# EasyEDA Pro project Chessboards.epro, board Diagonal (continued)
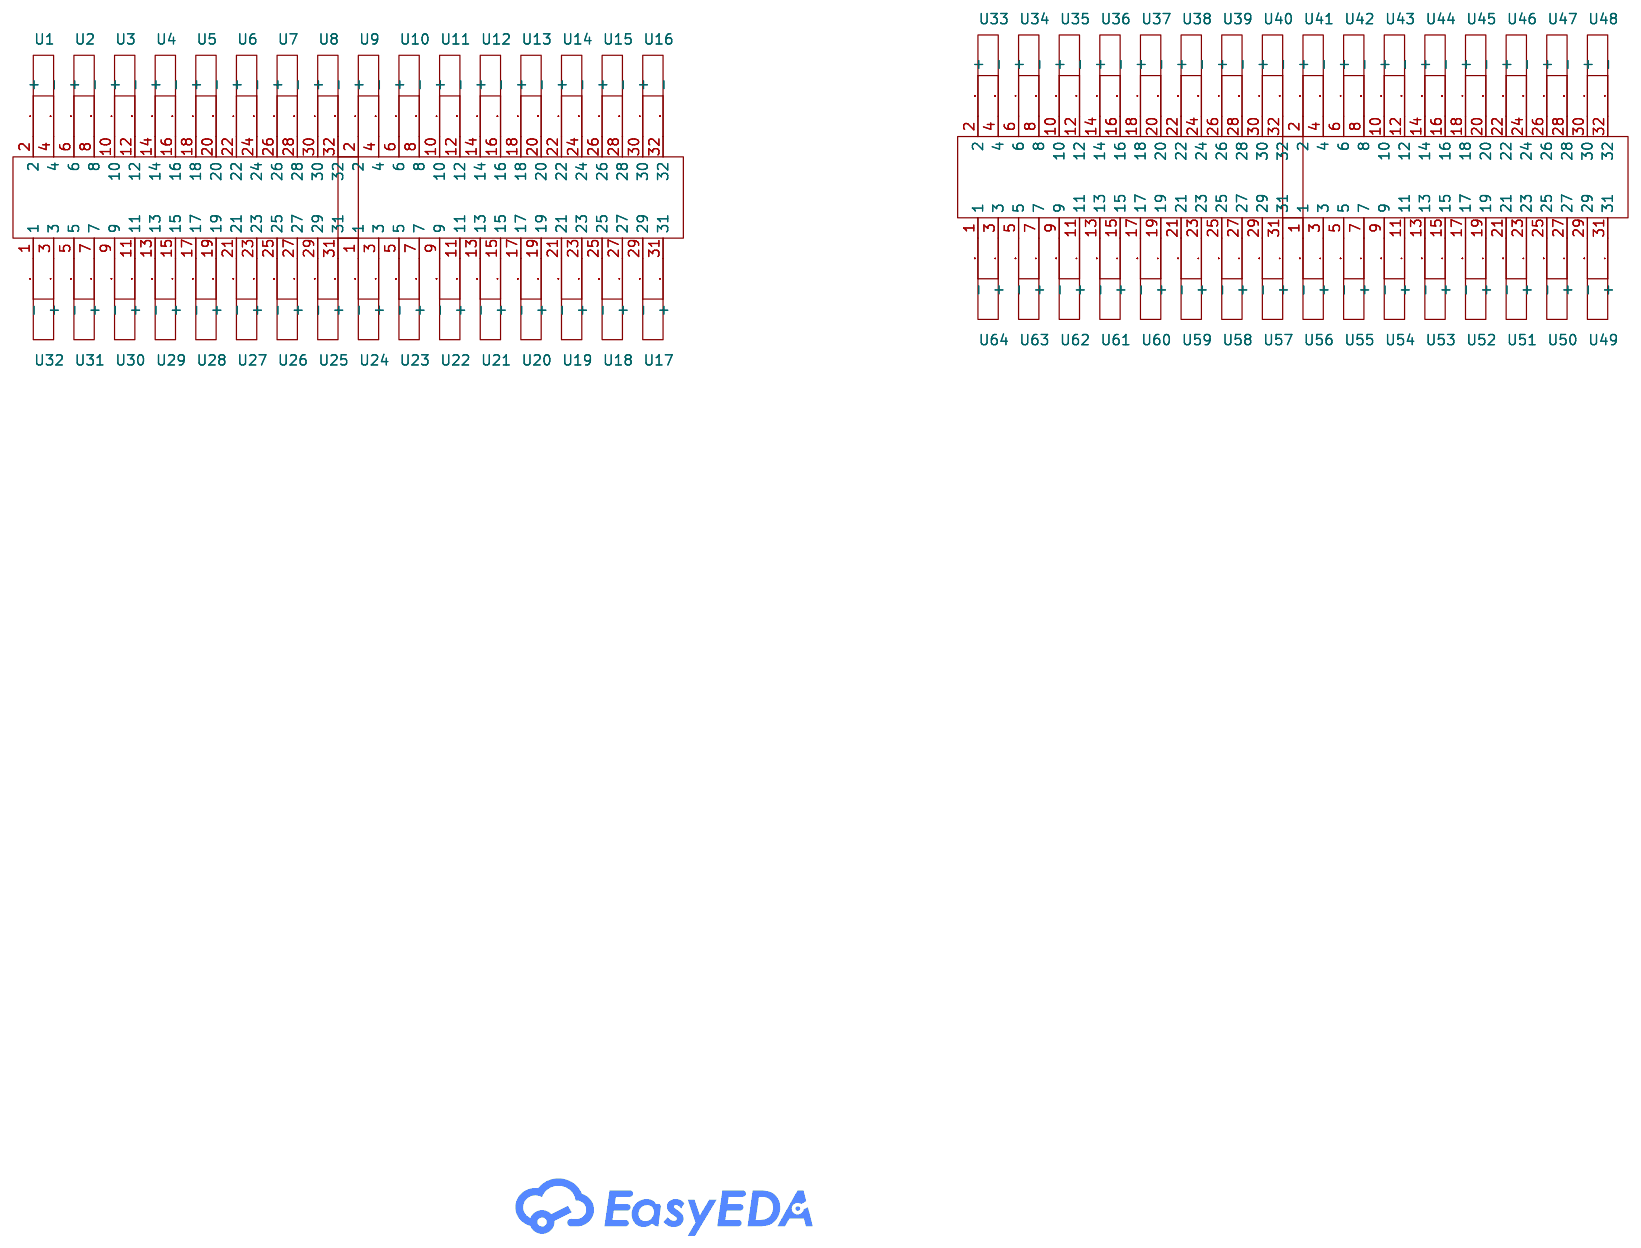
[diagram p0: schematic sheet]
## Routing (per net, layer and track width the routed paths; a pad name or vN(x,y) marks a point on that pad's centre or on a via; arc(x,y) is an arc through that point) (continued)
393.55,470.43 393.55,473.09 393.55,473.1 ; v2(243.69,476.35) 243.37,476.66 243.37,478.03 243.69,478.35 ; v2(302.61,3.69) 302.61,1.4 ; v2(241.14,476.35) 240.82,476.66 240.82,478.03 241.14,478.35 ; 290.01,6.99 290,6.99 290,9.65 v2(290.51,10.16) ; 164.57,472.99 164.45,472.99 164.44,472.98 164.44,470.86 165.43,469.87 ; v2(65.28,476.35) 65.28,478.64 ; 400.92,1.72 400.6,2.03 400.6,3.4 v2(400.92,3.72) ; 329.83,476.69 329.83,478.03 ; 329.83,476.69 v2(330.15,476.37) ; 329.83,478.03 329.83,478.06 330.15,478.37 ; 329.83,478.03 330.15,478.35 ; v2(137.75,476.36) 137.75,478.64 ; 445.15,7.01 445.15,7.01 445.15,9.67 v2(445.66,10.18) ; 387.04,476.4 387.04,478.68 ; v2(470.94,476.36) 470.94,478.64 ; v2(448.21,10.18) 447.7,9.67 447.7,7.01 447.7,7.01 ; 460.16,469.92 459.65,470.43 459.65,473.09 459.65,473.09 ; 149.33,473.07 149.33,470.41 149.84,469.9 ; v2(219.14,476.35) 219.14,478.64 ; v2(178.19,469.85) 177.23,470.82 177.23,472.96 177.23,472.96 ; v2(74.1,3.72) 73.78,3.4 73.78,2.03 74.1,1.72 ; 236.88,1.72 236.56,2.03 236.56,3.4 v2(236.88,3.72) ; 390.86,476.4 390.86,478.68 ; v2(76.74,476.35) 76.74,478.64 ; v2(57.84,10.19) 57.33,9.68 57.33,7.02 57.33,7.01 ; v2(212.32,3.71) 212.32,1.43 ; 304.02,6.99 304.02,6.99 304.02,9.65 v2(304.53,10.16) ; 159.47,472.99 159.47,472.98 159.47,470.74 160.33,469.87 ; v2(306.43,3.69) 306.43,1.4 ; 404.74,1.72 404.42,2.03 404.42,3.4 v2(404.74,3.72) ; 236.62,7.11 236.6,7.11 236.55,7.16 236.55,9.28 v2(237.48,10.22) ; v2(394.55,3.72) 394.23,3.4 394.23,2.03 394.55,1.72 ; v2(376.37,3.71) 376.37,1.43 ; v2(385.73,476.35) 385.73,478.64 ; 403.21,7.11 403.19,7.11 403.16,7.13 403.16,9.3 v2(404.07,10.22) ; v2(136.03,3.71) 136.03,1.42 ; v2(234.43,476.35) 234.43,478.64 ; 175.62,469.87 174.71,470.79 174.71,472.96 174.74,472.99 ; v2(63.38,469.88) 62.87,470.39 62.87,473.05 62.87,473.05 ; 315.82,476.69 315.82,476.66 316.13,476.35 ; 315.82,476.69 v2(316.13,476.37) ; 469.84,473.09 469.84,473.09 469.84,470.43 470.35,469.92 ; 315.88,470.74 v2(316.74,469.87) ; v2(236.35,469.88) 235.84,470.39 235.84,473.05 235.84,473.05 ; v2(455.65,476.36) 455.65,478.64 ; v2(395.82,3.72) 395.5,3.4 395.5,2.03 395.82,1.72 ; 162.27,476.37 161.96,476.69 161.96,478.06 162.27,478.37 ; v2(90.66,3.72) 90.34,3.4 90.34,2.03 90.66,1.72 ; 403.47,1.72 403.15,2.03 403.15,3.4 v2(403.47,3.72) ; v2(371.27,3.71) 371.27,1.43 ; 169.69,472.96 169.69,472.96 169.69,470.72 v2(170.55,469.85) ; 386.42,469.92 385.91,470.43 385.91,473.09 385.91,473.1 ; 288.73,6.99 288.73,6.99 288.73,9.65 v2(289.24,10.16) ; v2(321.23,476.37) 320.92,476.69 ; 320.92,476.69 320.92,476.66 321.23,476.35 ; v2(163.13,3.71) 162.81,3.4 162.81,2.03 163.13,1.71 ; v2(446.29,3.71) 446.29,1.42 ; v2(139.02,476.36) 139.02,478.64 ; 244.52,1.72 244.2,2.03 244.2,3.4 v2(244.52,3.72) ; v2(162.3,476.35) 161.98,476.67 161.98,478.03 162.3,478.35 ; v2(381.9,476.35) 381.9,478.64 ; 147.63,7.01 147.63,7.01 147.63,9.67 v2(148.14,10.18) ; 156.76,1.71 156.44,2.03 156.44,3.4 v2(156.76,3.71) ; 320.98,472.96 320.98,472.96 ; 327.35,472.96 327.35,472.98 327.35,472.99 ; 327.35,472.96 327.35,472.96 ; 238.59,478.35 238.28,478.03 238.28,476.66 v2(238.59,476.35) ; v2(219.34,10.19) 218.83,9.68 218.83,7.02 218.83,7.01 ; v2(59.74,3.71) 59.74,1.43 ; 463.33,476.39 463.33,478.68 ; v2(305.15,3.69) 305.15,1.4 ; 458.38,473.09 458.37,473.09 458.37,470.43 458.89,469.92 ; 169.25,469.87 168.39,470.74 168.39,472.98 ; 456.96,476.39 456.96,478.68 ; 166.12,478.35 165.8,478.03 165.8,476.67 v2(166.12,476.35) ; v2(151.13,469.88) 150.62,470.39 150.62,473.05 150.63,473.05 ; 59.05,473.05 59.04,473.05 59.04,470.39 v2(59.56,469.88) ; v2(366.17,3.71) 366.17,1.43 ; 176.29,478.37 175.97,478.06 175.97,476.69 176.29,476.37 ; 84.73,478.35 84.42,478.03 84.42,476.66 v2(84.73,476.35) ; 168.67,478.35 168.35,478.03 168.35,476.67 v2(168.67,476.35) ; v2(146.66,476.36) 146.66,478.64 ; v2(239.87,476.35) 239.55,476.66 239.55,478.03 239.87,478.35 ; 93.65,478.35 93.33,478.03 93.33,476.66 v2(93.65,476.35) ; v2(55.91,3.71) 55.91,1.43 ; v2(308.66,10.19) 307.79,9.33 307.79,7.08 307.8,7.08 ; 319.7,470.74 319.7,470.71 320.57,469.85 ; 319.7,470.74 v2(320.57,469.87) ; v2(52.09,3.71) 52.09,1.43 ; 304.32,476.35 304.32,478.66 ; 393.41,476.4 393.41,478.68 ; v2(158.48,476.35) 158.16,476.67 158.16,478.03 158.48,478.35 ; 155.7,473.07 155.7,470.41 156.21,469.9 ; v2(325.88,3.69) 325.57,3.38 325.57,2.01 325.88,1.69 ; 245.54,7.11 245.52,7.11 245.49,7.13 245.49,9.3 v2(246.4,10.22) ; 378.26,473.1 378.26,473.09 378.26,470.43 378.77,469.92 ; v2(456.48,3.71) 456.48,1.42 ; v2(303.88,3.69) 303.88,1.4 ; v2(377.64,3.71) 377.64,1.43 ; v2(472.21,476.36) 472.21,478.64 ; 395.64,469.89 394.78,470.76 394.78,473 394.78,473 ; v2(214.87,3.71) 214.87,1.43 ; 149.35,473.05 149.35,473.05 149.35,470.39 v2(149.86,469.88) ; 245.79,1.72 245.48,2.03 245.48,3.4 v2(245.79,3.72) ; 323.46,476.69 v2(323.78,476.37) ; 323.46,476.69 323.46,476.66 323.78,476.35 ; 165.68,1.71 165.36,2.03 165.36,3.4 v2(165.68,3.71) ; v2(229.33,476.35) 229.33,478.64 ; v2(379.36,476.35) 379.36,478.64 ; v2(298.78,3.69) 298.78,1.4 ; 169.5,1.71 169.18,2.03 169.18,3.4 v2(169.5,3.71) ; v2(335.25,476.37) 334.93,476.69 ; 334.93,476.69 334.93,476.66 335.25,476.35 ; v2(54.64,3.71) 54.64,1.43 ; v2(216.79,10.19) 216.28,9.68 216.28,7.02 216.29,7.01 ; 74.34,473.05 74.33,473.05 74.33,470.39 v2(74.84,469.88) ; v2(383.18,476.35) 383.18,478.64 ; 163.3,472.99 163.29,472.98 163.29,470.74 164.16,469.87 ; 379.4,476.4 379.4,478.68 ; 137.86,473.07 137.86,470.41 138.37,469.9 ; v2(61.45,476.35) 61.45,478.64 ; v2(464.12,3.71) 464.12,1.42 ; 172.21,472.98 172.21,470.74 173.07,469.87 ; v2(225.51,476.35) 225.51,478.64 ; 375.23,7.01 375.23,7.02 375.23,9.68 v2(375.74,10.19) ; v2(67.82,476.35) 67.82,478.64 ; v2(316.97,3.69) 316.65,3.38 316.65,2.01 316.97,1.69 ; 159.73,478.37 159.41,478.06 159.41,476.69 159.73,476.37 ; v2(72.92,476.35) 72.92,478.64 ; 240.45,7.11 240.44,7.11 240.44,9.35 v2(241.31,10.22) ; v2(156.23,469.88) 155.72,470.39 155.72,473.05 155.72,473.05 ; 303.05,476.35 303.05,478.66 ; v2(85.56,3.72) 85.25,3.4 85.25,2.03 85.56,1.72 ; 410.93,469.89 410.07,470.76 410.07,473 410.07,473 ; 156.83,476.38 156.83,478.66 ; 331.17,472.96 331.17,472.96 ; 168.64,476.37 168.33,476.69 168.33,478.06 168.64,478.37 ; 471.08,473.05 471.07,473.05 471.07,470.39 v2(471.58,469.88) ; v2(375.53,476.35) 375.53,478.64 ; v2(141.57,476.36) 141.57,478.64 ; v2(173.1,469.85) 172.23,470.72 172.23,472.96 172.24,472.96 ; 176.31,478.35 175.99,478.03 175.99,476.67 v2(176.31,476.35) ; 137.89,473.05 137.88,473.05 137.88,470.39 v2(138.39,469.88) ; 376.85,476.4 376.85,478.68 ; v2(248.34,3.72) 248.03,3.4 248.03,2.03 248.34,1.72 ; v2(294.96,3.69) 294.96,1.4 ; v2(460.12,469.88) 459.61,470.39 459.61,473.05 459.61,473.05 ; v2(70.37,476.35) 70.37,478.64 ; v2(235.7,476.35) 235.7,478.64 ; 154.28,476.38 154.28,478.66 ; v2(288.59,3.69) 288.59,1.4 ; 137.72,476.38 137.72,478.66 ; 387.92,7.11 387.92,7.11 387.92,9.35 v2(388.79,10.22) ; v2(249.39,469.85) 248.53,470.71 248.53,472.96 248.53,472.96 ; v2(378.08,476.35) 378.08,478.64 ; 314.52,478.66 v2(314.52,476.38) 314.52,476.35 ; 218,473.05 218,473.05 218,470.39 v2(218.51,469.88) ; v2(61.01,3.71) 61.01,1.43 ; v2(389.55,476.35) 389.55,478.64 ; v2(158.03,3.71) 157.71,3.4 157.71,2.03 158.03,1.71 ; 375.58,476.4 375.58,478.68 ; v2(71.65,476.35) 71.65,478.64 ; v2(147.94,476.36) 147.94,478.64 ; 466.53,469.92 466.02,470.43 466.02,473.09 466.02,473.09 ; v2(396.87,469.85) 396.01,470.71 396.01,472.96 396.01,472.96 ; v2(463.29,476.36) 463.29,478.64 ; v2(462.85,3.71) 462.85,1.42 ; v2(218.69,3.71) 218.69,1.43 ; v2(67.2,469.88) 66.69,470.39 66.69,473.05 66.69,473.05 ; v2(455.2,3.71) 455.2,1.42 ; 300.5,476.35 300.5,478.66 ; v2(173.76,476.35) 173.45,476.67 173.45,478.03 173.76,478.35 ; v2(453.93,3.71) 453.93,1.42 ; v2(221.69,476.35) 221.69,478.64 ; v2(221.24,3.71) 221.24,1.43 ; v2(222.96,476.35) 222.96,478.64 ; v2(129.66,3.71) 129.66,1.42 ; v2(88.11,3.72) 87.79,3.4 87.79,2.03 88.11,1.72 ; v2(151.76,476.36) 151.76,478.64 ; 149.19,476.38 149.19,478.66 ; 317.99,7.08 317.98,7.08 317.98,9.33 v2(318.85,10.19) ; v2(65.48,10.19) 64.97,9.68 64.97,7.02 64.97,7.01 ; 228.98,7.11 228.98,7.11 228.98,9.35 v2(229.84,10.22) ; 468.57,473.09 468.57,473.09 468.57,470.43 469.08,469.92 ; v2(385.28,3.71) 385.28,1.43 ; 148.08,473.05 148.07,473.05 148.07,470.39 v2(148.59,469.88) ; v2(89.38,3.72) 89.07,3.4 89.07,2.03 89.38,1.72 ; v2(147.49,3.71) 147.49,1.42 ; 171.8,469.87 170.94,470.74 170.94,472.98 ; v2(149.21,476.36) 149.21,478.64 ; v2(150.49,476.36) 150.49,478.64 ; v2(213.6,3.71) 213.6,1.43 ; v2(298.16,10.16) 297.65,9.65 297.65,6.99 297.65,6.99 ; 150.46,476.38 150.46,478.66 ; v2(211.05,3.71) 211.05,1.43 ; v2(91.71,469.85) 90.85,470.71 90.85,472.96 90.85,472.96 ; 454.41,476.39 454.41,478.68 ; 297.95,476.35 297.95,478.66 ; v2(82.18,476.35) 81.87,476.66 81.87,478.03 82.18,478.35 ; v2(387.51,10.22) 386.65,9.35 386.65,7.11 386.65,7.11 ; v2(78.02,476.35) 78.02,478.64 ; 464.61,476.39 464.61,478.68 ; v2(138.58,3.71) 138.58,1.42 ; 308.15,478.66 v2(308.15,476.38) 308.15,476.35 ; v2(224.23,476.35) 224.23,478.64 ; 151.74,476.38 151.74,478.66 ; v2(137.3,3.71) 137.3,1.42 ; v2(53.37,3.71) 53.37,1.43 ; v2(287.32,3.69) 287.32,1.4 ; v2(465.84,476.36) 465.84,478.64 ; 472.25,476.39 472.25,478.68 ; 453.14,476.39 453.14,478.68 ; v2(452.66,3.71) 452.66,1.42 ; v2(367.45,3.71) 367.45,1.43 ; v2(151.66,3.71) 151.34,3.4 151.34,2.03 151.66,1.71 ; 139,476.38 139,478.66 ; v2(139.85,3.71) 139.85,1.42 ; v2(226.34,3.71) 226.34,1.43 ; v2(446.94,10.18) 446.42,9.67 446.42,7.01 446.43,7.01 ; 460.78,476.39 460.78,478.68 ; v2(140.29,476.36) 140.29,478.64 ; v2(84.9,10.22) 84.03,9.35 84.03,7.11 84.04,7.11 ; v2(66.11,3.71) 66.11,1.43 ; v2(209.78,3.71) 209.78,1.43 ; v2(57.19,3.71) 57.19,1.43 ; 455.69,476.39 455.69,478.68 ; 143.81,7.01 143.81,7.01 143.81,9.67 v2(144.32,10.18) ; v2(390.73,3.72) 390.41,3.4 390.41,2.03 390.73,1.72 ; 470.98,476.39 470.98,478.68 ; 462.06,476.39 462.06,478.68 ; 383.22,476.4 383.22,478.68 ; v2(289.87,3.69) 289.87,1.4 ; v2(378.91,3.71) 378.91,1.43 ; v2(230.6,476.35) 230.6,478.64 ; 316.71,7.08 316.71,7.08 316.71,9.33 v2(317.57,10.19) ; 155.56,476.38 155.56,478.66 ; v2(148.77,3.71) 148.77,1.42 ; v2(217.42,3.71) 217.42,1.43 ; v2(156.86,476.36) 156.86,478.64 ; v2(58.91,476.35) 58.91,478.64 ; v2(292.41,3.69) 292.41,1.4
  vias: v1(47.13,53.21) v1(47.13,52.21) v1(48.13,53.21) v1(48.13,52.21) v1(49.13,53.21) v1(49.13,52.21) v1(50.13,53.21) v1(50.13,52.21) v1(51.13,53.21) v1(51.13,52.21) v1(52.13,53.21) v1(52.13,52.21) v1(53.13,53.21) v1(53.13,52.21) v1(54.13,53.21) v1(54.13,52.21) v1(55.13,53.21) v1(55.13,52.21) v1(55.22,408.02) v1(55.22,408.01) v1(55.22,407.02) v1(55.22,407.01) v1(56.13,53.21) v1(56.13,52.21) v1(56.22,408.02) v1(56.22,408.01) v1(56.22,407.02) v1(56.22,407.01) v1(57.13,53.21) v1(57.13,52.21) v1(57.22,408.02) v1(57.22,408.01) v1(57.22,407.02) v1(57.22,407.01) v1(58.13,53.21) v1(58.13,52.21) v1(58.22,408.02) v1(58.22,408.01) v1(58.22,407.02) v1(58.22,407.01) v1(59.22,408.02) v1(59.22,408.02) v1(59.22,407.02) v1(59.22,407.02) v1(60.22,408.02) v1(60.22,408.02) v1(60.22,407.02) v1(60.22,407.02) v1(61.22,408.02) v1(61.22,408.02) v1(61.22,407.02) v1(61.22,407.02) v1(62.22,408.02) v1(62.22,408.02) v1(62.22,407.02) v1(62.22,407.02) v1(63.22,408.02) v1(63.22,408.01) v1(63.22,407.02) v1(63.22,407.01) v1(64.22,408.02) v1(64.22,408.01) v1(64.22,407.02) v1(64.22,407.01) v1(65.22,408.02) v1(65.22,408.01) v1(65.22,407.02) v1(65.22,407.01) v1(66.22,408.02) v1(66.22,408.01) v1(66.22,407.02) v1(66.22,407.01) v1(82.54,53.21) v1(82.54,52.21) v1(83.54,53.21) v1(83.54,52.21) v1(84.54,53.21) v1(84.54,52.21) v1(85.54,53.21) v1(85.54,52.21) v1(86.54,53.21) v1(86.54,52.21) v1(87.54,53.21) v1(87.54,52.21) v1(88.54,53.21) v1(88.54,52.21) v1(89.54,53.21) v1(89.54,52.21) v1(90.54,53.21) v1(90.54,52.21) v1(90.65,408.02) v1(90.65,407.02) v1(91.54,53.21) v1(91.54,52.21) v1(91.65,408.02) v1(91.65,407.02) v1(92.54,53.21) v1(92.54,52.21) v1(92.65,408.02) v1(92.65,407.02) v1(93.54,53.21) v1(93.54,52.21) v1(93.65,408.02) v1(93.65,407.02) v1(94.54,53.21) v1(94.54,52.21) v1(94.62,408.02) v1(94.65,408.02) v1(94.62,407.02) v1(94.65,407.02) v1(95.54,53.21) v1(95.54,52.21) v1(95.62,408.02) v1(95.65,408.02) v1(95.62,407.02) v1(95.65,407.02) v1(96.54,53.21) v1(96.54,52.21) v1(96.62,408.02) v1(96.65,408.02) v1(96.62,407.02) v1(96.65,407.02) v1(97.54,53.21) v1(97.54,52.21) v1(97.62,408.02) v1(97.65,408.02) v1(97.62,407.02) v1(97.65,407.02) v1(98.65,408.02) v1(98.63,408.02) v1(98.65,407.02) v1(98.63,407.02) v1(99.65,408.02) v1(99.63,408.02) v1(99.65,407.02) v1(99.63,407.02) v1(100.65,408.02) v1(100.63,408.02) v1(100.65,407.02) v1(100.63,407.02) v1(101.65,408.02) v1(101.63,408.02) v1(101.65,407.02) v1(101.63,407.02) v1(102.63,408.02) v1(102.65,408.02) v1(102.63,407.02) v1(102.65,407.02) v1(103.63,408.02) v1(103.65,408.02) v1(103.63,407.02) v1(103.65,407.02) v1(104.63,408.02) v1(104.65,408.02) v1(104.63,407.02) v1(104.65,407.02) v1(105.63,408.02) v1(105.65,408.02) v1(105.63,407.02) v1(105.65,407.02) v1(121.94,53.21) v1(121.94,53.21) v1(121.97,53.21) v1(121.97,53.21) v1(121.94,52.21) v1(121.94,52.21) v1(121.97,52.21) v1(121.97,52.21) v1(122.94,53.21) v1(122.94,53.21) v1(122.97,53.21) v1(122.97,53.21) v1(122.94,52.21) v1(122.94,52.21) v1(122.97,52.21) v1(122.97,52.21) v1(123.94,53.21) v1(123.94,53.21) v1(123.97,53.21) v1(123.97,53.21) v1(123.94,52.21) v1(123.94,52.21) v1(123.97,52.21) v1(123.97,52.21) v1(124.94,53.21) v1(124.94,53.21) v1(124.97,53.21) v1(124.97,53.21) v1(124.94,52.21) v1(124.94,52.21) v1(124.97,52.21) v1(124.97,52.21) v1(125.97,53.21) v1(125.94,53.21) v1(125.94,53.21) v1(125.97,53.2) v1(125.97,52.21) v1(125.94,52.21) v1(125.94,52.21) v1(125.97,52.2) v1(126.97,53.21) v1(126.94,53.21) v1(126.94,53.21) v1(126.97,53.2) v1(126.97,52.21) v1(126.94,52.21) v1(126.94,52.21) v1(126.97,52.2) v1(127.97,53.21) v1(127.94,53.21) v1(127.94,53.21) v1(127.97,53.2) v1(127.97,52.21) v1(127.94,52.21) v1(127.94,52.21) v1(127.97,52.2) v1(128.97,53.21) v1(128.94,53.21) v1(128.94,53.21) v1(128.97,53.2) v1(128.97,52.21) v1(128.94,52.21) v1(128.94,52.21) v1(128.97,52.2) v1(129.95,53.21) v1(129.97,53.21) v1(129.95,53.21) v1(129.97,53.21) v1(129.95,52.21) v1(129.97,52.21) v1(129.95,52.21) v1(129.97,52.21) v1(130.05,408.02) v1(130.05,408.02) v1(130.05,408.02) v1(130.03,408.02) v1(130.03,408.02) v1(130.03,408.02) v1(130.05,407.02) v1(130.05,407.02) v1(130.05,407.02) v1(130.03,407.02) v1(130.03,407.02) v1(130.95,53.21) v1(130.95,53.21) v1(130.97,53.21) v1(130.97,53.21) v1(130.95,52.21) v1(130.97,52.21) v1(130.95,52.21) v1(130.97,52.21) v1(131.05,408.02) v1(131.05,408.02) v1(131.05,408.02) v1(131.03,408.02) v1(131.03,408.02) v1(131.03,408.02) v1(131.05,407.02) v1(131.05,407.02) v1(131.05,407.02) v1(131.03,407.02) v1(131.03,407.02) v1(131.95,53.21) v1(131.97,53.21) v1(131.95,53.21) v1(131.97,53.21) v1(131.95,52.21) v1(131.97,52.21) v1(131.95,52.21) v1(131.97,52.21) v1(132.05,408.02) v1(132.05,408.02) v1(132.05,408.02) v1(132.03,408.02) v1(132.03,408.02) v1(132.03,408.02) v1(132.05,407.02) v1(132.05,407.02) v1(132.05,407.02) v1(132.03,407.02) v1(132.03,407.02) v1(132.95,53.21) v1(132.97,53.21) v1(132.95,53.21) v1(132.97,53.21) v1(132.95,52.21) v1(132.95,52.21) v1(132.97,52.21) v1(132.97,52.21) v1(133.05,408.02) v1(133.05,408.02) v1(133.05,408.02) v1(133.03,408.02) v1(133.03,408.02) v1(133.03,408.02) v1(133.05,407.02) v1(133.05,407.02) v1(133.05,407.02) v1(133.03,407.02) v1(133.03,407.02) v1(133.95,53.21) v1(133.95,53.21) v1(133.97,53.2) v1(133.95,52.21) v1(133.95,52.21) v1(133.97,52.2) v1(134.05,408.03) v1(134.03,408.02) v1(134.03,408.02) v1(134.03,408.02) v1(134.05,408.02) v1(134.05,408.02) v1(134.05,407.03) v1(134.03,407.02) v1(134.03,407.02) v1(134.03,407.02) v1(134.05,407.02) v1(134.05,407.02) v1(134.95,53.21) v1(134.95,53.21) v1(134.97,53.2) v1(134.95,52.21) v1(134.95,52.21) v1(134.97,52.2) v1(135.05,408.03) v1(135.03,408.02) v1(135.03,408.02) v1(135.03,408.02) v1(135.05,408.02) v1(135.05,408.02) v1(135.05,407.03) v1(135.03,407.02) v1(135.03,407.02) v1(135.03,407.02) v1(135.05,407.02) v1(135.05,407.02) v1(135.95,53.21) v1(135.95,53.21) v1(135.97,53.2) v1(135.95,52.21) v1(135.95,52.21) v1(135.97,52.2) v1(136.05,408.03) v1(136.03,408.02) v1(136.03,408.02) v1(136.03,408.02) v1(136.05,408.02) v1(136.05,408.02) v1(136.05,407.03) v1(136.03,407.02) v1(136.03,407.02) v1(136.03,407.02) v1(136.05,407.02) v1(136.05,407.02) v1(136.95,53.21) v1(136.95,53.21) v1(136.97,53.2) v1(136.95,52.21) v1(136.95,52.21) v1(136.97,52.2) v1(137.05,408.03) v1(137.03,408.02) v1(137.03,408.02) v1(137.03,408.02) v1(137.05,408.02) v1(137.05,408.02) v1(137.05,407.03) v1(137.03,407.02) v1(137.03,407.02) v1(137.03,407.02) v1(137.05,407.02) v1(137.05,407.02) v1(138.06,408.02) v1(138.06,408.02) v1(138.04,408.02) v1(138.06,408.02) v1(138.04,408.02) v1(138.04,408.02) v1(138.06,407.02) v1(138.04,407.02) v1(138.06,407.02) v1(138.06,407.02) v1(138.04,407.02) v1(138.04,407.02) v1(139.06,408.02) v1(139.04,408.02) v1(139.06,408.02) v1(139.04,408.02) v1(139.06,408.02) v1(139.04,408.02) v1(139.06,407.02) v1(139.06,407.02) v1(139.04,407.02) v1(139.06,407.02) v1(139.04,407.02) v1(139.04,407.02) v1(140.06,408.02) v1(140.06,408.02) v1(140.06,408.02) v1(140.04,408.02) v1(140.04,408.02) v1(140.04,408.02) v1(140.06,407.02) v1(140.06,407.02) v1(140.06,407.02) v1(140.04,407.02) v1(140.04,407.02) v1(140.04,407.02) v1(141.06,408.02) v1(141.04,408.02) v1(141.04,408.02) v1(141.06,408.02) v1(141.06,408.02) v1(141.04,408.02) v1(141.06,407.02) v1(141.04,407.02) v1(141.06,407.02) v1(141.04,407.02) v1(141.06,407.02) v1(141.04,407.02) v1(142.06,408.03) v1(142.04,408.02) v1(142.04,408.02) v1(142.04,408.02) v1(142.06,408.02) v1(142.06,408.02) v1(142.06,407.03) v1(142.04,407.02) v1(142.04,407.02) v1(142.04,407.02) v1(142.06,407.02) v1(142.06,407.02) v1(143.06,408.03) v1(143.04,408.02) v1(143.04,408.02) v1(143.04,408.02) v1(143.06,408.02) v1(143.06,408.02) v1(143.06,407.03) v1(143.04,407.02) v1(143.04,407.02) v1(143.04,407.02) v1(143.06,407.02) v1(143.06,407.02) v1(144.06,408.03) v1(144.04,408.02) v1(144.04,408.02) v1(144.04,408.02) v1(144.06,408.02) v1(144.06,408.02) v1(144.06,407.03) v1(144.04,407.02) v1(144.04,407.02) v1(144.04,407.02) v1(144.06,407.02) v1(144.06,407.02) v1(145.06,408.03) v1(145.04,408.02) v1(145.04,408.02) v1(145.04,408.02) v1(145.06,408.02) v1(145.06,408.02) v1(145.06,407.03) v1(145.04,407.02) v1(145.04,407.02) v1(145.04,407.02) v1(145.06,407.02) v1(145.06,407.02) v1(161.38,53.22) v1(161.35,53.21) v1(161.38,53.21) v1(161.4,53.2) v1(161.38,52.22) v1(161.35,52.21) v1(161.38,52.21) v1(161.4,52.2) v1(162.38,53.22) v1(162.35,53.21) v1(162.38,53.21) v1(162.4,53.2) v1(162.38,52.22) v1(162.35,52.21) v1(162.38,52.21) v1(162.4,52.2) v1(163.38,53.22) v1(163.35,53.21) v1(163.38,53.21) v1(163.4,53.2) v1(163.38,52.22) v1(163.35,52.21) v1(163.38,52.21) v1(163.4,52.2) v1(164.38,53.22) v1(164.35,53.21) v1(164.38,53.21) v1(164.4,53.2) v1(164.38,52.22) v1(164.35,52.21) v1(164.38,52.21) v1(164.4,52.2) v1(165.38,53.21) v1(165.35,53.21) v1(165.4,53.21) v1(165.38,53.2) v1(165.38,52.21) v1(165.35,52.21) v1(165.4,52.21) v1(165.38,52.2) v1(166.38,53.21) v1(166.35,53.21) v1(166.4,53.21) v1(166.38,53.2) v1(166.38,52.21) v1(166.35,52.21) v1(166.4,52.21) v1(166.38,52.2) v1(167.38,53.21) v1(167.35,53.21) v1(167.4,53.21) v1(167.38,53.2) v1(167.38,52.21) v1(167.35,52.21) v1(167.4,52.21) v1(167.38,52.2) v1(168.38,53.21) v1(168.35,53.21) v1(168.4,53.21) v1(168.38,53.2) v1(168.38,52.21) v1(168.35,52.21) v1(168.4,52.21) v1(168.38,52.2) v1(169.38,53.22) v1(169.36,53.21) v1(169.38,53.21) v1(169.38,52.22) v1(169.36,52.21) v1(169.38,52.21) v1(169.49,408.03) v1(169.46,408.02) v1(169.46,408.02) v1(169.44,408.02) v1(169.44,408.02) v1(169.46,408.01) v1(169.49,407.03) v1(169.46,407.02) v1(169.46,407.02) v1(169.44,407.02) v1(169.44,407.02) v1(169.46,407.01) v1(169.4,53.2) v1(169.4,52.2) v1(170.38,53.22) v1(170.36,53.21) v1(170.38,53.21) v1(170.38,52.22) v1(170.36,52.21) v1(170.38,52.21) v1(170.49,408.03) v1(170.46,408.02) v1(170.46,408.02) v1(170.44,408.02) v1(170.44,408.02) v1(170.46,408.01) v1(170.49,407.03) v1(170.46,407.02) v1(170.46,407.02) v1(170.44,407.02) v1(170.44,407.02) v1(170.46,407.01) v1(170.4,53.2) v1(170.4,52.2) v1(171.38,53.22) v1(171.36,53.21) v1(171.38,53.21) v1(171.38,52.22) v1(171.36,52.21) v1(171.38,52.21) v1(171.49,408.03) v1(171.46,408.02) v1(171.46,408.02) v1(171.44,408.02) v1(171.44,408.02) v1(171.46,408.01) v1(171.49,407.03) v1(171.46,407.02) v1(171.46,407.02) v1(171.44,407.02) v1(171.44,407.02) v1(171.46,407.01) v1(171.4,53.2) v1(171.4,52.2) v1(172.38,53.22) v1(172.36,53.21) v1(172.38,53.21) v1(172.38,52.22) v1(172.36,52.21) v1(172.38,52.21) v1(172.49,408.03) v1(172.46,408.02) v1(172.46,408.02) v1(172.44,408.02) v1(172.44,408.02) v1(172.46,408.01) v1(172.49,407.03) v1(172.46,407.02) v1(172.46,407.02) v1(172.44,407.02) v1(172.44,407.02) v1(172.46,407.01) v1(172.4,53.2) v1(172.4,52.2) v1(173.38,53.21) v1(173.36,53.21) v1(173.38,53.2) v1(173.38,52.21) v1(173.36,52.21) v1(173.38,52.2) v1(173.46,408.03) v1(173.49,408.02) v1(173.44,408.02) v1(173.44,408.02) v1(173.46,408.02) v1(173.46,408.02) v1(173.46,407.03) v1(173.49,407.02) v1(173.44,407.02) v1(173.44,407.02) v1(173.46,407.02) v1(173.46,407.02) v1(173.4,53.21) v1(173.4,52.21) v1(174.38,53.21) v1(174.36,53.21) v1(174.38,53.2) v1(174.38,52.21) v1(174.36,52.21) v1(174.38,52.2) v1(174.46,408.03) v1(174.49,408.02) v1(174.44,408.02) v1(174.44,408.02) v1(174.46,408.02) v1(174.46,408.02) v1(174.46,407.03) v1(174.49,407.02) v1(174.44,407.02) v1(174.44,407.02) v1(174.46,407.02) v1(174.46,407.02) v1(174.4,53.21) v1(174.4,52.21) v1(175.38,53.21) v1(175.36,53.21) v1(175.38,53.2) v1(175.38,52.21) v1(175.36,52.21) v1(175.38,52.2) v1(175.46,408.03) v1(175.49,408.02) v1(175.44,408.02) v1(175.44,408.02) v1(175.46,408.02) v1(175.46,408.02) v1(175.46,407.03) v1(175.49,407.02) v1(175.44,407.02) v1(175.44,407.02) v1(175.46,407.02) v1(175.46,407.02) v1(175.4,53.21) v1(175.4,52.21) v1(176.38,53.21) v1(176.36,53.21) v1(176.38,53.2) v1(176.38,52.21) v1(176.36,52.21) v1(176.38,52.2) v1(176.46,408.03) v1(176.49,408.02) v1(176.44,408.02) v1(176.44,408.02) v1(176.46,408.02) v1(176.46,408.02) v1(176.46,407.03) v1(176.49,407.02) v1(176.44,407.02) v1(176.44,407.02) v1(176.46,407.02) v1(176.46,407.02) v1(176.4,53.21) v1(176.4,52.21) v1(177.49,408.03) v1(177.47,408.02) v1(177.44,408.02) v1(177.47,408.02) v1(177.44,408.02) v1(177.47,408.01) v1(177.49,407.03) v1(177.47,407.02) v1(177.47,407.02) v1(177.44,407.02) v1(177.44,407.02) v1(177.47,407.01) v1(178.49,408.03) v1(178.47,408.02) v1(178.44,408.02) v1(178.44,408.02) v1(178.47,408.02) v1(178.47,408.01) v1(178.49,407.03) v1(178.47,407.02) v1(178.44,407.02) v1(178.47,407.02) v1(178.44,407.02) v1(178.47,407.01) v1(179.49,408.03) v1(179.47,408.02) v1(179.47,408.02) v1(179.44,408.02) v1(179.44,408.02) v1(179.47,408.01) v1(179.49,407.03) v1(179.47,407.02) v1(179.47,407.02) v1(179.44,407.02) v1(179.44,407.02) v1(179.47,407.01) v1(180.49,408.03) v1(180.47,408.02) v1(180.44,408.02) v1(180.47,408.02) v1(180.44,408.02) v1(180.47,408.01) v1(180.49,407.03) v1(180.47,407.02) v1(180.47,407.02) v1(180.44,407.02) v1(180.44,407.02) v1(180.47,407.01) v1(181.47,408.03) v1(181.44,408.02) v1(181.44,408.02) v1(181.49,408.02) v1(181.47,408.02) v1(181.47,408.02) v1(181.47,407.03) v1(181.44,407.02) v1(181.44,407.02) v1(181.49,407.02) v1(181.47,407.02) v1(181.47,407.02) v1(182.47,408.03) v1(182.44,408.02) v1(182.44,408.02) v1(182.49,408.02) v1(182.47,408.02) v1(182.47,408.02) v1(182.47,407.03) v1(182.44,407.02) v1(182.44,407.02) v1(182.49,407.02) v1(182.47,407.02) v1(182.47,407.02) v1(183.47,408.03) v1(183.44,408.02) v1(183.44,408.02) v1(183.49,408.02) v1(183.47,408.02) v1(183.47,408.02) v1(183.47,407.03) v1(183.44,407.02) v1(183.44,407.02) v1(183.49,407.02) v1(183.47,407.02) v1(183.47,407.02) v1(184.47,408.03) v1(184.44,408.02) v1(184.44,408.02) v1(184.49,408.02) v1(184.47,408.02) v1(184.47,408.02) v1(184.47,407.03) v1(184.44,407.02) v1(184.44,407.02) v1(184.49,407.02) v1(184.47,407.02) v1(184.47,407.02) v1(200.81,52.21) v1(200.81,52.21) v1(200.81,52.21) v1(200.81,52.21) v1(201.81,52.21) v1(201.81,52.21) v1(201.81,52.21) v1(201.81,52.21) v1(202.81,52.21) v1(202.81,52.21) v1(202.81,52.21) v1(202.81,52.21) v1(203.81,52.21) v1(203.81,52.21) v1(203.81,52.21) v1(203.81,52.21) v1(204.81,53.22) v1(204.81,53.21) v1(204.81,53.21) v1(204.81,53.21) v1(204.81,52.22) v1(204.81,52.21) v1(204.81,52.21) v1(204.81,52.21) v1(205.81,53.22) v1(205.81,53.21) v1(205.81,53.21) v1(205.81,53.21) v1(205.81,52.22) v1(205.81,52.21) v1(205.81,52.21) v1(205.81,52.21) v1(206.81,53.22) v1(206.81,53.21) v1(206.81,53.21) v1(206.81,53.21) v1(206.81,52.22) v1(206.81,52.21) v1(206.81,52.21) v1(206.81,52.21) v1(207.81,53.22) v1(207.81,53.21) v1(207.81,53.21) v1(207.81,53.21) v1(207.81,52.22) v1(207.81,52.21) v1(207.81,52.21) v1(207.81,52.21) v1(208.82,53.21) v1(208.82,53.21) v1(208.82,53.21) v1(208.82,53.21) v1(208.82,52.21) v1(208.82,52.21) v1(208.82,52.21) v1(208.82,52.21) v1(209.82,53.21) v1(209.82,53.21) v1(209.82,53.21) v1(209.82,53.21) v1(209.82,52.21) v1(209.82,52.21) v1(209.82,52.21) v1(209.82,52.21) v1(210.82,53.21) v1(210.82,53.21) v1(210.82,53.21) v1(210.82,53.21) v1(210.82,52.21) v1(210.82,52.21) v1(210.82,52.21) v1(210.82,52.21) v1(211.82,53.21) v1(211.82,53.21) v1(211.82,53.21) v1(211.82,53.21) v1(211.82,52.21) v1(211.82,52.21) v1(211.82,52.21) v1(211.82,52.21) v1(212.9,408.02) v1(212.9,408.02) v1(212.9,408.02) v1(212.9,408.02) v1(212.9,408.01) v1(212.9,408.01) v1(212.9,407.02) v1(212.9,407.02) v1(212.9,407.02) v1(212.9,407.02) v1(212.9,407.01) v1(212.9,407.01) v1(212.82,53.22) v1(212.82,53.21) v1(212.82,53.21) v1(212.82,53.21) v1(212.82,52.22) v1(212.82,52.21) v1(212.82,52.21) v1(212.82,52.21) v1(213.9,408.02) v1(213.9,408.02) v1(213.9,408.02) v1(213.9,408.02) v1(213.9,408.01) v1(213.9,408.01) v1(213.9,407.02) v1(213.9,407.02) v1(213.9,407.02) v1(213.9,407.02) v1(213.9,407.01) v1(213.9,407.01) v1(213.82,53.22) v1(213.82,53.21) v1(213.82,53.21) v1(213.82,53.21) v1(213.82,52.22) v1(213.82,52.21) v1(213.82,52.21) v1(213.82,52.21) v1(214.9,408.02) v1(214.9,408.02) v1(214.9,408.02) v1(214.9,408.02) v1(214.9,408.01) v1(214.9,408.01) v1(214.9,407.02) v1(214.9,407.02) v1(214.9,407.02) v1(214.9,407.02) v1(214.9,407.01) v1(214.9,407.01) v1(214.82,53.22) v1(214.82,53.21) v1(214.82,53.21) v1(214.82,53.21) v1(214.82,52.22) v1(214.82,52.21) v1(214.82,52.21) v1(214.82,52.21) v1(215.9,408.02) v1(215.9,408.02) v1(215.9,408.02) v1(215.9,408.02) v1(215.9,408.01) v1(215.9,408.01) v1(215.9,407.02) v1(215.9,407.02) v1(215.9,407.02) v1(215.9,407.02) v1(215.9,407.01) v1(215.9,407.01) v1(215.82,53.22) v1(215.82,53.21) v1(215.82,53.21) v1(215.82,53.21) v1(215.82,52.22) v1(215.82,52.21) v1(215.82,52.21) v1(215.82,52.21) v1(216.9,408.02) v1(216.9,408.02) v1(216.9,408.02) v1(216.9,408.02) v1(216.9,408.02) v1(216.9,408.02) v1(216.9,407.02) v1(216.9,407.02) v1(216.9,407.02) v1(216.9,407.02) v1(216.9,407.02) v1(216.9,407.02) v1(217.9,408.02) v1(217.9,408.02) v1(217.9,408.02) v1(217.9,408.02) v1(217.9,408.02) v1(217.9,408.02) v1(217.9,407.02) v1(217.9,407.02) v1(217.9,407.02) v1(217.9,407.02) v1(217.9,407.02) v1(217.9,407.02) v1(218.9,408.02) v1(218.9,408.02) v1(218.9,408.02) v1(218.9,408.02) v1(218.9,408.02) v1(218.9,408.02) v1(218.9,407.02) v1(218.9,407.02) v1(218.9,407.02) v1(218.9,407.02) v1(218.9,407.02) v1(218.9,407.02) v1(219.9,408.02) v1(219.9,408.02) v1(219.9,408.02) v1(219.9,408.02) v1(219.9,408.02) v1(219.9,408.02) v1(219.9,407.02) v1(219.9,407.02) v1(219.9,407.02) v1(219.9,407.02) v1(219.9,407.02) v1(219.9,407.02) v1(220.9,408.02) v1(220.9,408.02) v1(220.9,408.02) v1(220.9,408.02) v1(220.9,408.01) v1(220.9,408.01) v1(220.9,407.02) v1(220.9,407.02) v1(220.9,407.02) v1(220.9,407.02) v1(220.9,407.01) v1(220.9,407.01) v1(221.9,408.02) v1(221.9,408.02) v1(221.9,408.02) v1(221.9,408.02) v1(221.9,408.01) v1(221.9,408.01) v1(221.9,407.02) v1(221.9,407.02) v1(221.9,407.02) v1(221.9,407.02) v1(221.9,407.01) v1(221.9,407.01) v1(222.9,408.02) v1(222.9,408.02) v1(222.9,408.02) v1(222.9,408.02) v1(222.9,408.01) v1(222.9,408.01) v1(222.9,407.02) v1(222.9,407.02) v1(222.9,407.02) v1(222.9,407.02) v1(222.9,407.01) v1(222.9,407.01) v1(223.9,408.02) v1(223.9,408.02) v1(223.9,408.02) v1(223.9,408.02) v1(223.9,408.01) v1(223.9,408.01) v1(223.9,407.02) v1(223.9,407.02) v1(223.9,407.02) v1(223.9,407.02) v1(223.9,407.01) v1(223.9,407.01) v1(240.22,53.21) v1(240.22,53.21) v1(240.22,53.21) v1(240.24,53.21) v1(240.22,52.21) v1(240.22,52.21) v1(240.22,52.21) v1(240.24,52.21) v1(241.22,53.21) v1(241.22,53.21) v1(241.22,53.21) v1(241.24,53.21) v1(241.22,52.21) v1(241.22,52.21) v1(241.22,52.21) v1(241.24,52.21) v1(242.22,53.21) v1(242.22,53.21) v1(242.22,53.21) v1(242.24,53.21) v1(242.22,52.21) v1(242.22,52.21) v1(242.22,52.21) v1(242.24,52.21) v1(243.22,53.21) v1(243.22,53.21) v1(243.22,53.21) v1(243.24,53.21) v1(243.22,52.21) v1(243.22,52.21) v1(243.22,52.21) v1(243.24,52.21) v1(244.24,53.21) v1(244.22,53.21) v1(244.22,53.21) v1(244.22,53.21) v1(244.24,52.21) v1(244.22,52.21) v1(244.22,52.21) v1(244.22,52.21) v1(245.24,53.21) v1(245.22,53.21) v1(245.22,53.21) v1(245.22,53.21) v1(245.24,52.21) v1(245.22,52.21) v1(245.22,52.21) v1(245.22,52.21) v1(246.24,53.21) v1(246.22,53.21) v1(246.22,53.21) v1(246.22,53.21) v1(246.24,52.21) v1(246.22,52.21) v1(246.22,52.21) v1(246.22,52.21) v1(247.24,53.21) v1(247.22,53.21) v1(247.22,53.21) v1(247.22,53.21) v1(247.24,52.21) v1(247.22,52.21) v1(247.22,52.21) v1(247.22,52.21) v1(248.22,53.21) v1(248.22,53.21) v1(248.22,53.21) v1(248.25,53.21) v1(248.22,52.21) v1(248.22,52.21) v1(248.22,52.21) v1(248.25,52.21) v1(248.33,408.02) v1(248.33,408.02) v1(248.33,407.02) v1(248.33,407.02) v1(249.22,53.21) v1(249.22,53.21) v1(249.22,53.21) v1(249.25,53.21) v1(249.22,52.21) v1(249.22,52.21) v1(249.22,52.21) v1(249.25,52.21) v1(249.33,408.02) v1(249.33,408.02) v1(249.33,407.02) v1(249.33,407.02) v1(250.22,53.21) v1(250.22,53.21) v1(250.22,53.21) v1(250.25,53.21) v1(250.22,52.21) v1(250.22,52.21) v1(250.22,52.21) v1(250.25,52.21) v1(250.33,408.02) v1(250.33,408.02) v1(250.33,407.02) v1(250.33,407.02) v1(251.22,53.21) v1(251.22,53.21) v1(251.22,53.21) v1(251.25,53.21) v1(251.22,52.21) v1(251.22,52.21) v1(251.22,52.21) v1(251.25,52.21) v1(251.33,408.02) v1(251.33,408.02) v1(251.33,407.02) v1(251.33,407.02) v1(252.22,53.21) v1(252.22,53.21) v1(252.22,53.21) v1(252.25,52.21) 